# EasyEDA Pro project 智能车.eprj, schematic V203无感无刷

## Sheets
1 P1: Create Date: 2024-01-20; Page Name: P1; Project Name: 智能车; Schematic Name: Schematic1; Update Date: 2024-01-21; Company: 嘉立创EDA; Page Size: A4; Version: V1.0
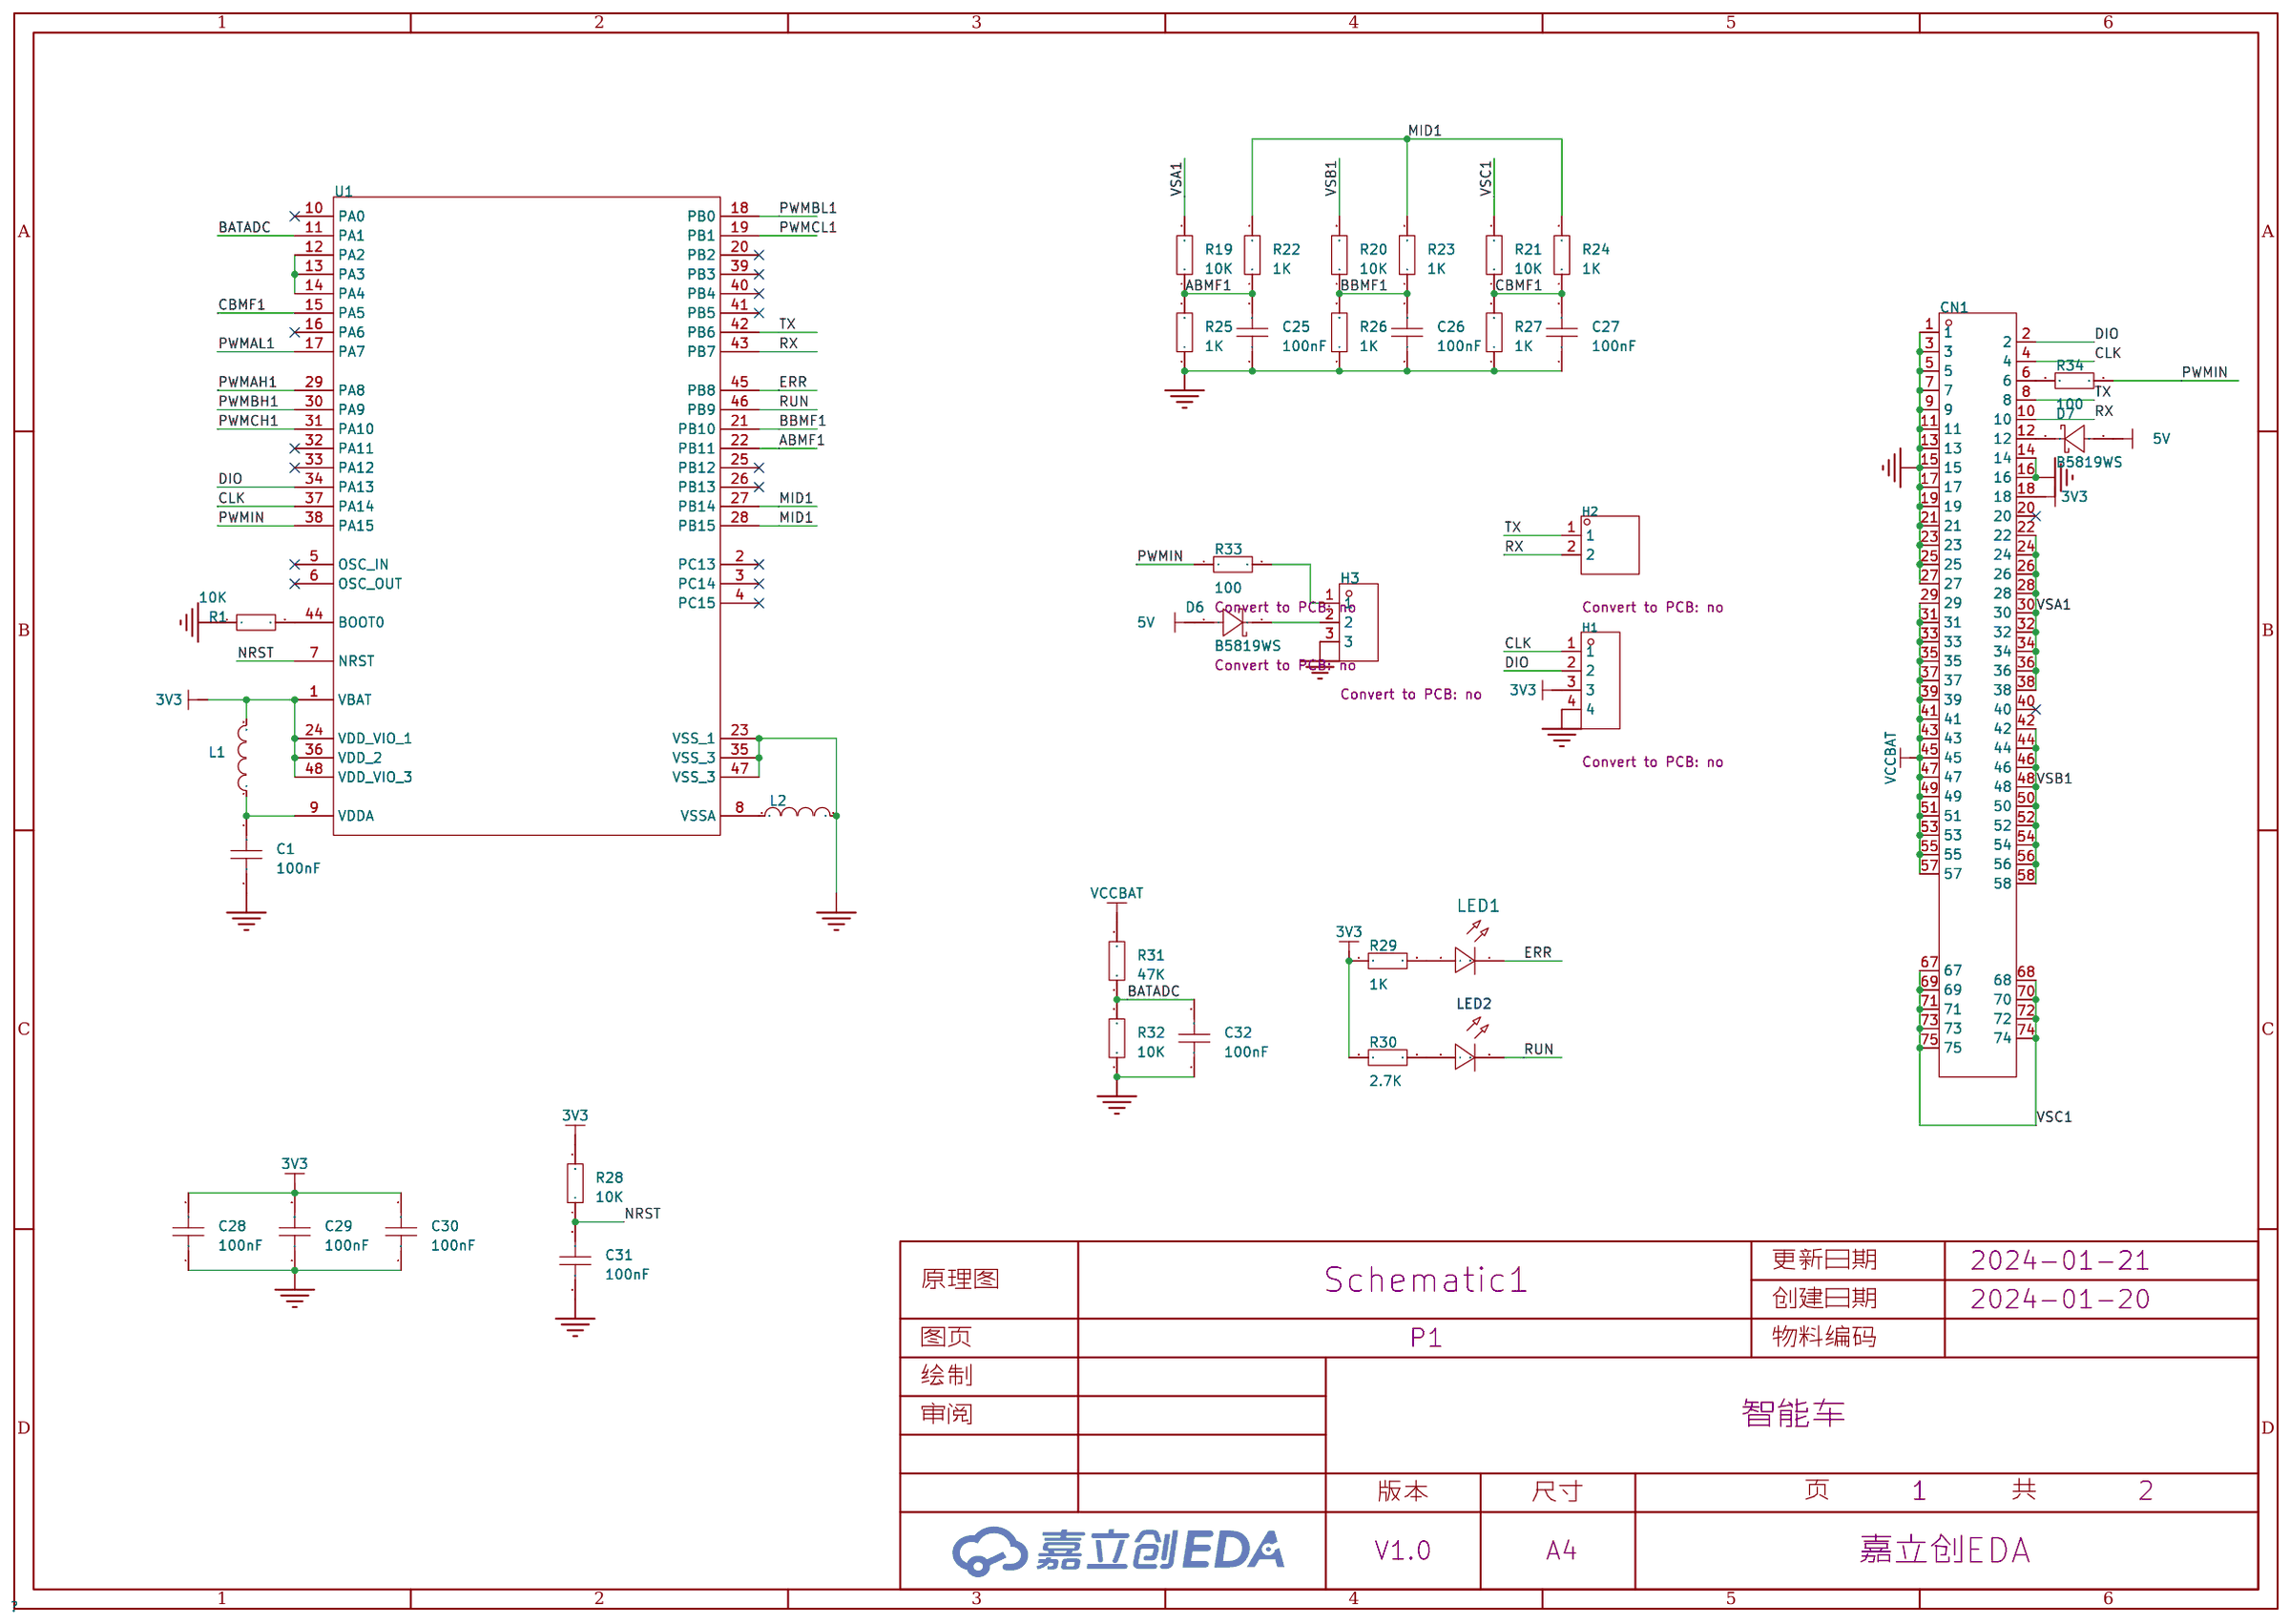
[diagram p4: P1]
2 P2: Create Date: 2024-01-21; Page Name: P2
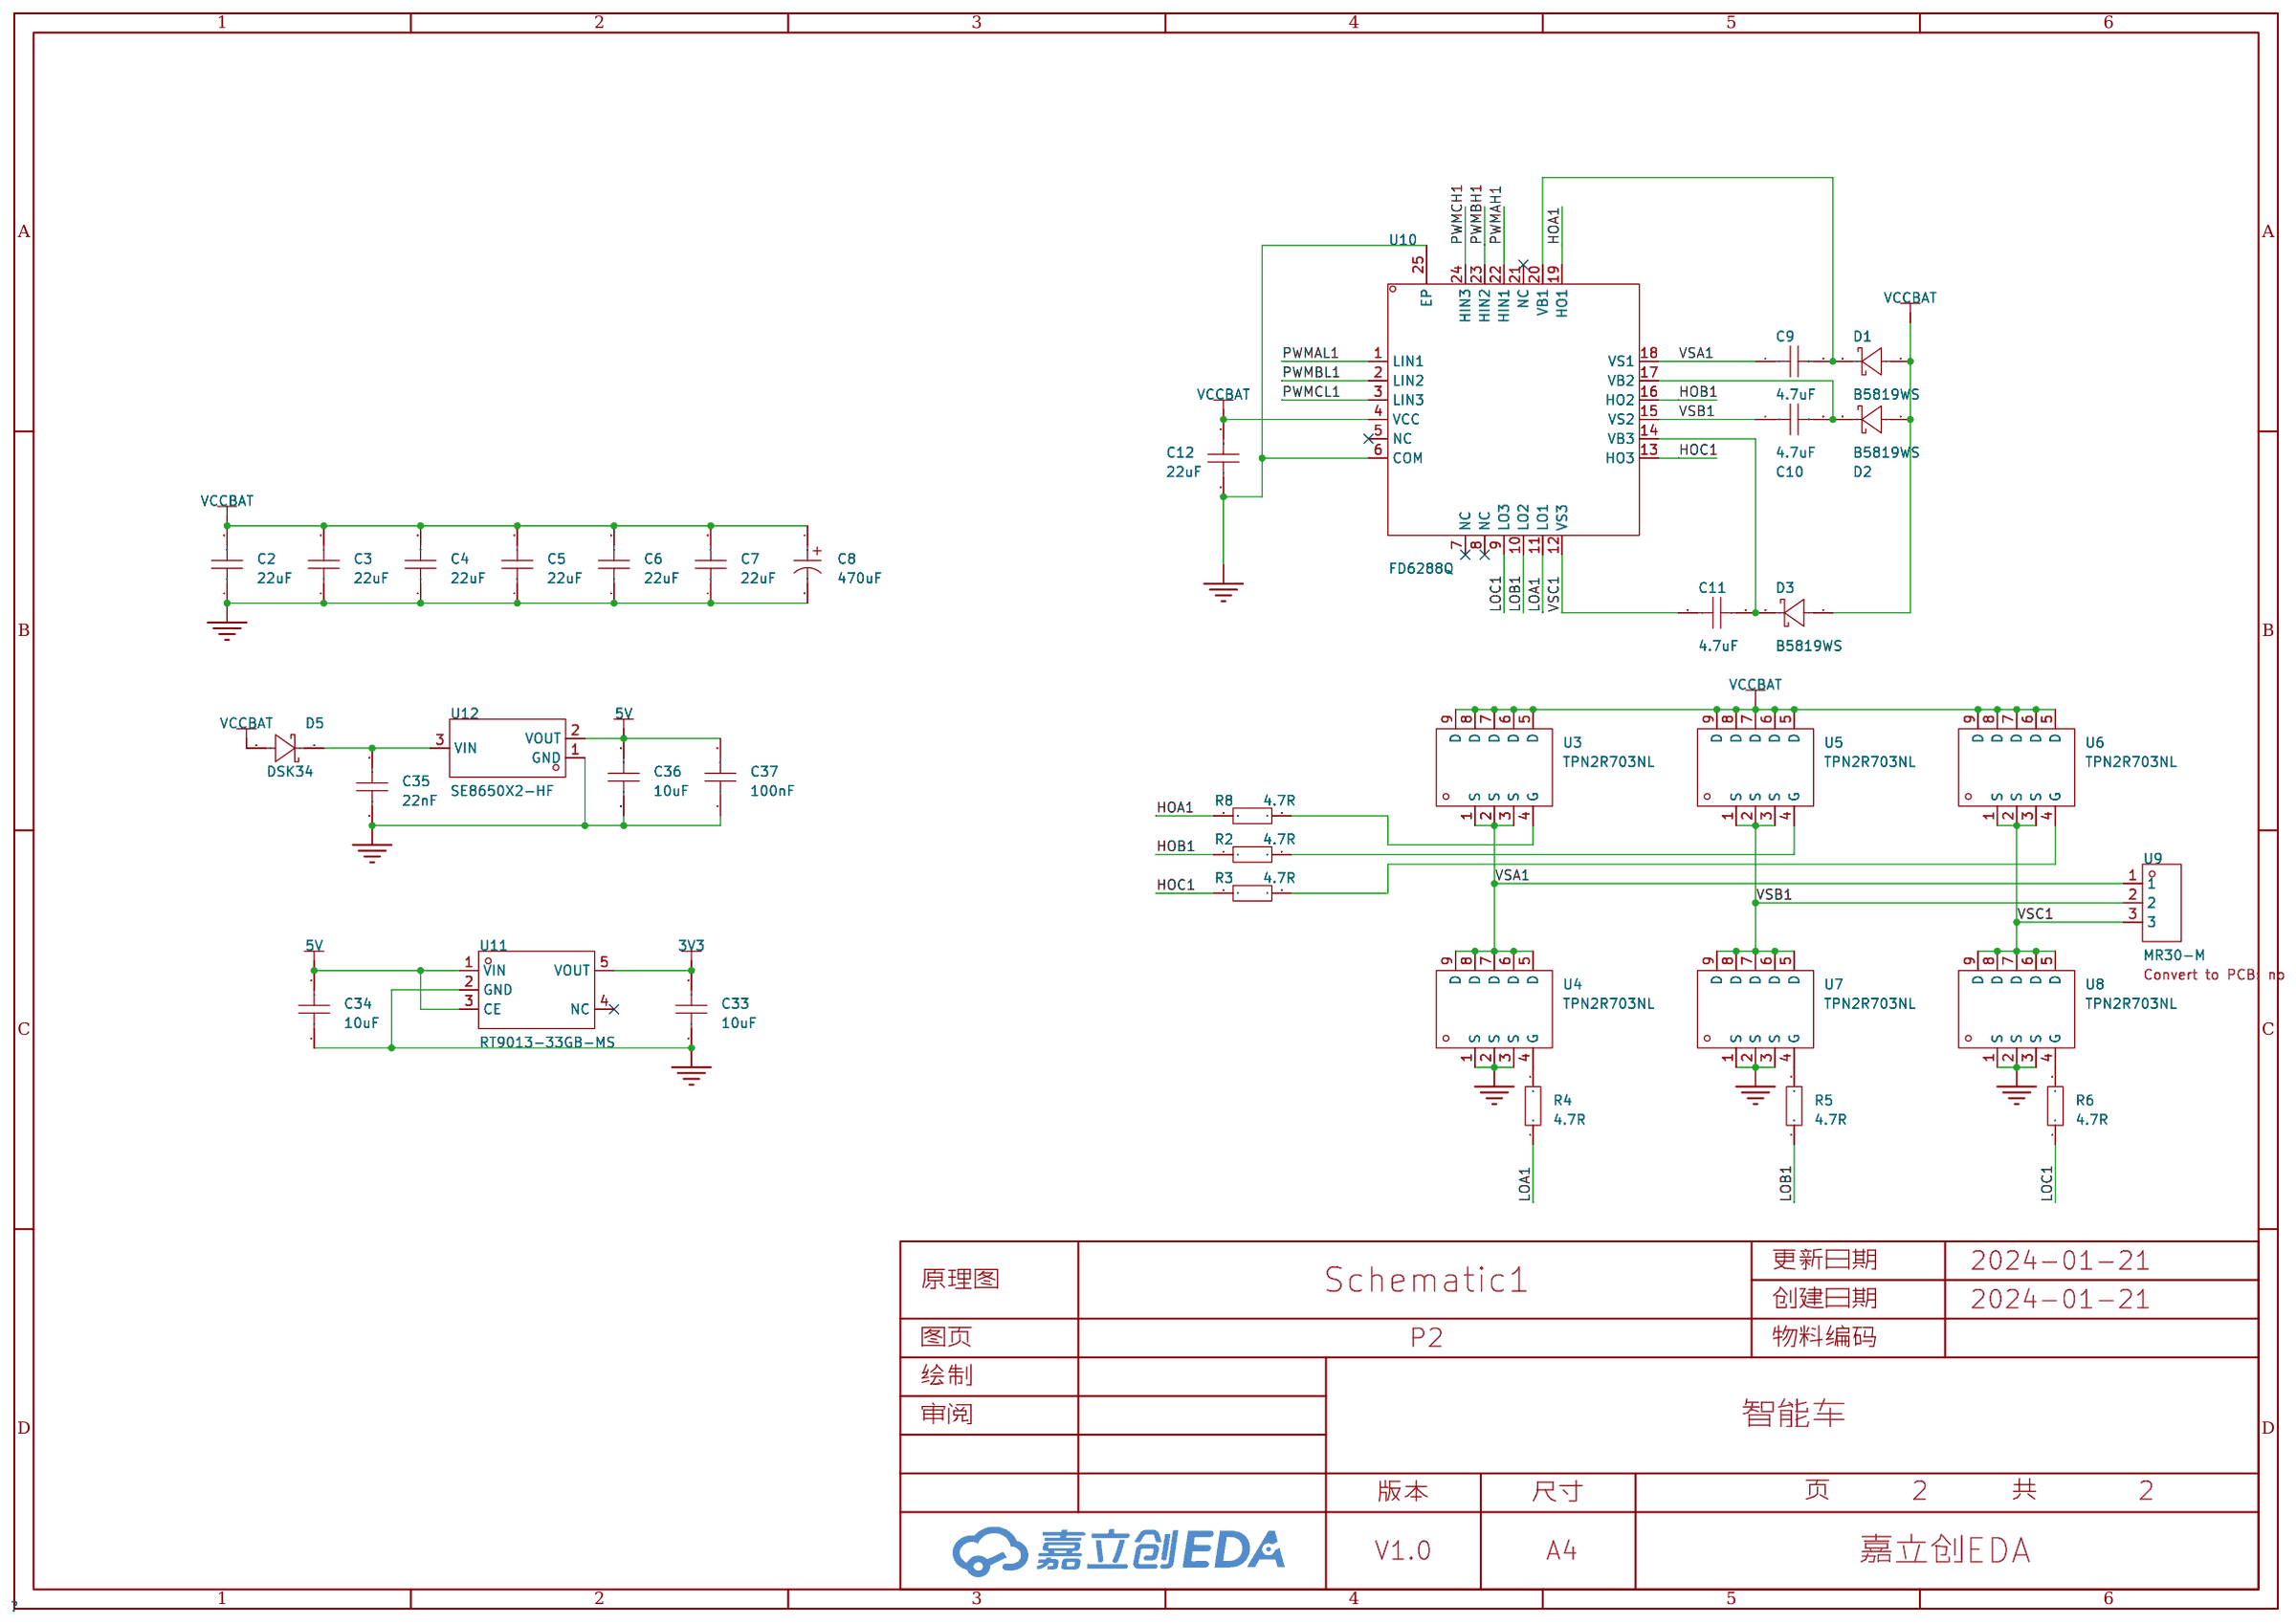
[diagram p5: P2]

## Parts
sheet P1
C1  100nF  [C0402]
C25  100nF  [C0402]
C26  100nF  [C0402]
C27  100nF  [C0402]
C28  100nF  [C0402]
C29  100nF  [C0402]
C30  100nF  [C0402]
C31  100nF  [C0402]
C32  100nF  [C0402]
CN1  91302-42-067RDM  [M.2_M-KEY]
D6  B5819WS  [SOD-323_L1.7-W1.3-LS2.5-FD]
D7  B5819WS  [SOD-323_L1.7-W1.3-LS2.5-FD]
H1  -  [HDR-TH_4P-P2.54-V-M]
H2  -  [HDR-TH_2P-P2.54-V-M-1]
H3  -  [HDR-TH_3P-P2.54-V-M]
L1  CBG100505U000T  [L0402]
L2  CBG100505U000T  [L0402]
LED1  -  [LED_0402]
LED2  -  [LED_0402]
R1  10K  [R0402]
R19  10K  [R0402]
R20  10K  [R0402]
R21  10K  [R0402]
R22  1K  [R0402]
R23  1K  [R0402]
R24  1K  [R0402]
R25  1K  [R0402]
R26  1K  [R0402]
R27  1K  [R0402]
R28  10K  [R0402]
R29  1K  [R0402]
R30  2.7K  [R0402]
R31  47K  [R0402]
R32  10K  [R0402]
R33  100  [R0402]
R34  100  [R0201]
U1  -  [LQFP-48_48P-L7.0-W7.0-P0.50-LS9.7-BL]
sheet P2
C2  22uF  [C0805]
C3  22uF  [C0805]
C4  22uF  [C0805]
C5  22uF  [C0805]
C6  22uF  [C0805]
C7  22uF  [C0805]
C8  470uF  [CAP-SMD_BD10.0-L10.3-W10.3-LS11.3-FD]
C9  4.7uF  [C0402]
C10  4.7uF  [C0402]
C11  4.7uF  [C0402]
C12  22uF  [C0805]
C33  10uF  [C0402]
C34  10uF  [C0402]
C35  22nF  [C0805]
C36  10uF  [C0402]
C37  100nF  [C0402]
D1  B5819WS  [SOD-323_L1.7-W1.3-LS2.5-FD]
D2  B5819WS  [SOD-323_L1.7-W1.3-LS2.5-FD]
D3  B5819WS  [SOD-323_L1.7-W1.3-LS2.5-FD]
D5  DSK34  [SOD-123FL_L2.7-W1.8-LS3.8-RD]
R2  4.7R  [R0402]
R3  4.7R  [R0402]
R4  4.7R  [R0402]
R5  4.7R  [R0402]
R6  4.7R  [R0402]
R8  4.7R  [R0402]
U3  TPN2R703NL  [TSON-8_L3.1-W3.1-P0.65-LS3.3-BL-EP]
U4  TPN2R703NL  [TSON-8_L3.1-W3.1-P0.65-LS3.3-BL-EP]
U5  TPN2R703NL  [TSON-8_L3.1-W3.1-P0.65-LS3.3-BL-EP]
U6  TPN2R703NL  [TSON-8_L3.1-W3.1-P0.65-LS3.3-BL-EP]
U7  TPN2R703NL  [TSON-8_L3.1-W3.1-P0.65-LS3.3-BL-EP]
U8  TPN2R703NL  [TSON-8_L3.1-W3.1-P0.65-LS3.3-BL-EP]
U9  MR30-M  [CONN-TH_MR30-M]
U10  FD6288Q  [QFN-24_L4.0-W4.0-P0.50-BL-EP2.6]
U11  RT9013-33GB-MS  [SOT-23-5_L2.9-W1.6-P0.95-LS2.8-BR]
U12  SE8650X2-HF  [SOT-23-3_L2.9-W1.6-P1.90-LS2.8-BR]

## Library data of the parts
C1 C28-C34 C36 C37 = CAP_0402: Supplier Footprint: 0402
C9-C11 C25-C27 = CAP_0603: Supplier Footprint: 0603
CN1 = 91302-42-067RDM: 连接器类型:M.2;间距:0.5mm;引脚总数:67P;工作温度范围:-40℃~+80℃;; LCSC Part Name: 0.5mm P数:67P; Supplier Part: C601195; Manufacturer: UMaxconn(友贸); Supplier Footprint: SMD,P=0.5mm; JLCPCB Part Class: Extended Part; Datasheet: https://atta.szlcsc.com/upload/public/pdf/source/20210511/C1509730_FC1345B298657A7EB9D210DEA51B9F3C.pdf; Supplier: LCSC; Connector Type: M.2; Pitch: 0.5mm; Number of Pins: 67P; Height Above Board: 4.2mm; Contact Material: 铜合金; Contact Plating: 金; Operating Temperature Range: -40℃~+80℃
D1-D3 D6 D7 = B5819WS_C7420331: 二极管配置:独立式;直流反向耐压(Vr):40V;平均整流电流(Io):1A;正向压降(Vf):600mV@1.0A;; LCSC Part Name: 电压:40V 电流:1A; Supplier Part: C7420331; Manufacturer: 宏迦橙; Supplier Footprint: SOD-323; JLCPCB Part Class: Extended Part; Datasheet: https://atta.szlcsc.com/upload/public/pdf/source/20230828/03CA0F4F90DAE368A7153B7B5E4D0651.pdf; Supplier: LCSC; Diode Configuration: 独立式; Reverse Voltage (Vr): 40V; Average Rectified Current (Io): 1A; Forward Voltage (Vf@If): 600mV@1.0A; Reverse Leakage Current (Ir): 1mA@40V; Peak forward surge current: 10A
H1 = HDR-M_2.54_1x4P: Supplier Part: C492403; Supplier Footprint: 插件
H2 = HDR-M_2.54_1x2P: Supplier Part: C124375; Supplier Footprint: 插件
H3 = HDR-M_2.54_1x3P: Supplier Part: C2937625; Supplier Footprint: 插件
L1 L2 = CBG100505U000T: 标称阻抗@测试频率:0Ω@100MHz;直流电阻(RDC):100mΩ;; LCSC Part Name: 单路 0402磁珠 阻抗0Ω@100MHz; Supplier Part: C139137; Manufacturer: FH(风华); Supplier Footprint: 0402; JLCPCB Part Class: Extended Part; Datasheet: https://atta.szlcsc.com/upload/public/pdf/source/20180917/C294510_876BBCD5BD7C9EF2E8468360D8BC49D0.pdf; Supplier: LCSC; Impedance @ Frequency: 0Ω@100MHz; DC Resistance: 100mΩ; Current Rating: 300mA; Circuits: 1
LED1 = LED_0402-R: Supplier Footprint: 0402
LED2 = LED_0402-G: Supplier Footprint: 0402
R1 R28-R34 = Res_0402: Supplier Footprint: 0402
R2-R6 R8 R19-R27 = Res_0603: Supplier Footprint: 0603
U1 = CH32V203C8T6
C2-C7 C12 C35 = CAP_0805: Supplier Footprint: 0805
C8 = XT470UF35V90RV0080: 容值:470uF;精度:±20%;额定电压:35V;纹波电流:310mA@120Hz;等效串联电阻:-;; LCSC Part Name: 470uF ±20% 35V; Supplier Part: C2992611; Manufacturer: KNSCHA(科尼盛); Supplier Footprint: SMD,D10xL10.5mm; JLCPCB Part Class: Extended Part; Datasheet: https://atta.szlcsc.com/upload/public/pdf/source/20220628/C969EE689908AD9C2F3DF9F92FD62901.pdf; Supplier: LCSC; Tolerance: ±20%; Rated Voltage: 35V; Ripple Current: 310mA@120Hz; φD: 10mm; L: 10.5mm; Lifetime @ Temp: 2000hrs@105℃; Operating Temperature: -55℃~+105℃
D5 = DSK34_C727076: 二极管配置:独立式;正向压降(Vf):520mV@3A;直流反向耐压(Vr):40V;平均整流电流(Io):3A;; LCSC Part Name: 电压:40V 电流:3A; Supplier Part: C727076; Manufacturer: TWGMC(台湾迪嘉); Supplier Footprint: SOD-123FL; JLCPCB Part Class: Extended Part; Datasheet: https://atta.szlcsc.com/upload/public/pdf/source/20200828/C727076_B37FCA1E25E95F22A97D5A5D18D72E25.pdf; Supplier: LCSC; Diode Configuration: 独立式; Forward Voltage (Vf@If): 520mV@3A; Reverse Voltage (Vr): 40V; Average Rectified Current (Io): 3A; Reverse Leakage Current (Ir): 500uA@40V
U3-U8 = TPN2R703NL: Supplier Part: C2939631; Supplier Footprint: TSON-8; JLCPCB Part Class: 扩展库; Supplier: LCSC
U9 = MR30-M: 模型锂电连接器（两件套） 三芯; LCSC Part Name: AMASS(艾迈斯)锂电池三芯电源连接器公头MR30-M 2件套; Supplier Part: C99873; Manufacturer: AMASS(艾迈斯); JLCPCB Part Class: Extended Part; Datasheet: https://atta.szlcsc.com/upload/public/pdf/source/20170412/1491969315720.pdf; Supplier: LCSC
U10 = FD6288Q: Supplier Part: C328453; Manufacturer: Fortior Tech(峰岹); Supplier Footprint: QFN-24-EP(4x4); JLCPCB Part Class: 扩展库; Datasheet: https://atta.szlcsc.com/upload/public/pdf/source/20181108/C328453_785547738DB9FC0123219FC22539EFAD.pdf; Supplier: LCSC
U11 = RT9013-33GB-MS: 输出类型:固定;最大输入电压:5.5V;输出电压:3.3V;输出电流:500mA;电源纹波抑制比(PSRR):75dB@(1kHz);输出极性:正极;; Supplier Part: C7434207; Manufacturer: MSKSEMI(美森科); Supplier Footprint: SOT-23-5; JLCPCB Part Class: 扩展库; Datasheet: https://atta.szlcsc.com/upload/public/pdf/source/20230705/1D6536D82D93AC1E044F3DAE104751D9.pdf; Supplier: LCSC; Output Type: 固定; Maximum Input Voltage: 5.5V; Output Voltage: 3.3V; Output Current: 500mA; Power Supply Rejection Ratio (PSRR): 75dB@(1kHz); Output Polarity: 正极
U12 = SE8650X2-HF: 输出类型:固定;输出极性:正;最大输入电压:80V;输出电压:5V;输出电流:200mA;电源纹波抑制比(PSRR):85dB;; LCSC Part Name: 输入80V 输出5V 200mA; Supplier Part: C496615; Manufacturer: SEAWARD(思旺); Supplier Footprint: SOT-23; JLCPCB Part Class: 扩展库; Datasheet: https://atta.szlcsc.com/upload/public/pdf/source/20220321/29E2D6E65CE42ECBE76E8EC1E13AE65C.pdf; Supplier: LCSC; Output Type: 固定; Output Polarity: 正; Number of Outputs: 1; Maximum Input Voltage: 80V; Output Voltage: 5V; Dropout Voltage: 700mV@(100mA); Quiescent Current (Ground Current): 2uA; Output Current: 200mA; Power Supply Rejection Ratio (PSRR): 85dB

## Nets
3V3: C28.2 C29.2 C30.2 C33.2 CN1.18 H1.3 L1.2 R28.2 R29.1 R30.1 U1.1(VBAT) U1.24(VDD_VIO_1) U1.36(VDD_2) U1.48(VDD_VIO_3) U11.5(VOUT)
5V: C34.2 C36.2 C37.2 D6.1(A) D7.1(A) U11.1(VIN) U11.3(CE) U12.2(VOUT)
GND: C1.1 C2.1 C3.1 C4.1 C5.1 C6.1 C7.1 C8.2 C12.1 C25.1 C26.1 C27.1 C28.1 C29.1 C30.1 C31.1 C32.1 C33.1 C34.1 C35.1 C36.1 C37.1 CN1.1 CN1.3 CN1.5 CN1.7 CN1.9 CN1.11 CN1.13 CN1.14 CN1.15 CN1.16 CN1.17 CN1.19 CN1.21 CN1.23 CN1.25 CN1.27 H1.4 H3.3 L2.2 R1.1 R25.1 R26.1 R27.1 R32.1 U1.23(VSS_1) U1.35(VSS_3) U1.47(VSS_3) U4.1(S) U4.2(S) U4.3(S) U7.1(S) U7.2(S) U7.3(S) U8.1(S) U8.2(S) U8.3(S) U10.6(COM) U10.25(EP) U11.2(GND) U12.1(GND)
VCCBAT: C2.2 C3.2 C4.2 C5.2 C6.2 C7.2 C8.1 C12.2 CN1.29 CN1.31 CN1.33 CN1.35 CN1.37 CN1.39 CN1.41 CN1.43 CN1.45 CN1.47 CN1.49 CN1.51 CN1.53 CN1.55 CN1.57 D1.1(A) D2.1(A) D3.1(A) D5.2(A) R31.2 U3.5(D) U3.6(D) U3.7(D) U3.8(D) U3.9(D) U5.5(D) U5.6(D) U5.7(D) U5.8(D) U5.9(D) U6.5(D) U6.6(D) U6.7(D) U6.8(D) U6.9(D) U10.4(VCC)
ABMF1: C25.2 R19.1 R22.1 R25.2 U1.22(PB11)
BATADC: C32.2 R31.1 R32.2 U1.11(PA1)
BBMF1: C26.2 R20.1 R23.1 R26.2 U1.21(PB10)
CBMF1: C27.2 R21.1 R24.1 R27.2 U1.15(PA5)
CLK: CN1.4 H1.1 U1.37(PA14)
DIO: CN1.2 H1.2 U1.34(PA13)
ERR: LED1.1(C) U1.45(PB8)
HOA1: R8.1 U10.19(HO1)
HOB1: R2.1 U10.16(HO2)
HOC1: R3.1 U10.13(HO3)
LOA1: R4.1 U10.11(LO1)
LOB1: R5.1 U10.10(LO2)
LOC1: R6.1 U10.9(LO3)
MID1: R22.2 R23.2 R24.2 U1.27(PB14) U1.28(PB15)
NRST: C31.2 R28.1 U1.7(NRST)
PWMAH1: U1.29(PA8) U10.22(HIN1)
PWMAL1: U1.17(PA7) U10.1(LIN1)
PWMBH1: U1.30(PA9) U10.23(HIN2)
PWMBL1: U1.18(PB0) U10.2(LIN2)
PWMCH1: U1.31(PA10) U10.24(HIN3)
PWMCL1: U1.19(PB1) U10.3(LIN3)
PWMIN: R33.1 R34.1 U1.38(PA15)
RUN: LED2.1(C) U1.46(PB9)
RX: CN1.10 H2.2 U1.43(PB7)
TX: CN1.8 H2.1 U1.42(PB6)
VSA1: C9.1 CN1.22 CN1.24 CN1.26 CN1.28 CN1.30 CN1.32 CN1.34 CN1.36 CN1.38 R19.2 U3.1(S) U3.2(S) U3.3(S) U4.5(D) U4.6(D) U4.7(D) U4.8(D) U4.9(D) U9.1 U10.18(VS1)
VSB1: C10.1 CN1.42 CN1.44 CN1.46 CN1.48 CN1.50 CN1.52 CN1.54 CN1.56 CN1.58 R20.2 U5.1(S) U5.2(S) U5.3(S) U7.5(D) U7.6(D) U7.7(D) U7.8(D) U7.9(D) U9.2 U10.15(VS2)
VSC1: C11.1 CN1.67 CN1.68 CN1.69 CN1.70 CN1.71 CN1.72 CN1.73 CN1.74 CN1.75 R21.2 U6.1(S) U6.2(S) U6.3(S) U8.5(D) U8.6(D) U8.7(D) U8.8(D) U8.9(D) U9.3 U10.12(VS3)
$1N1069: R1.2 U1.44(BOOT0)
$1N1347: C1.2 L1.1 U1.9(VDDA)
$1N1396: L2.1 U1.8(VSSA)
$1N1527: U1.12(PA2) U1.13(PA3) U1.14(PA4)
$1N2236: LED1.2(A) R29.2
$1N2286: LED2.2(A) R30.2
$1N6623: CN1.6 R34.2
$1N6887: CN1.12 D7.2(K)
$2N1275: R8.2 U3.4(G)
$2N1276: R3.2 U6.4(G)
$2N1277: R2.2 U5.4(G)
$2N1296: R5.2 U7.4(G)
$2N1297: R6.2 U8.4(G)
$2N1333: C10.2 D2.2(K) U10.17(VB2)
$2N1334: C11.2 D3.2(K) U10.14(VB3)
$2N1335: C9.2 D1.2(K) U10.20(VB1)
$2N1336: R4.2 U4.4(G)
$2N2310: C35.2 D5.1(K) U12.3(VIN)
Net-(D6-2): D6.2(K) H3.2
Net-(H3-1): H3.1 R33.2

Not connected (* = marked no-connect by the designer): CN1 20* 40*; U1 2(PC13)* 3(PC14)* 4(PC15)* 5(OSC_IN)* 6(OSC_OUT)* 10(PA0)* 16(PA6)* 20(PB2)* 25(PB12)* 26(PB13)* 32(PA11)* 33(PA12)* 39(PB3)* 40(PB4)* 41(PB5)*; U10 5(NC)* 7(NC)* 8(NC)* 21(NC)*; U11 4(NC)*
